# Altium schematic sheet Array.SchDoc (part 3 of 3)
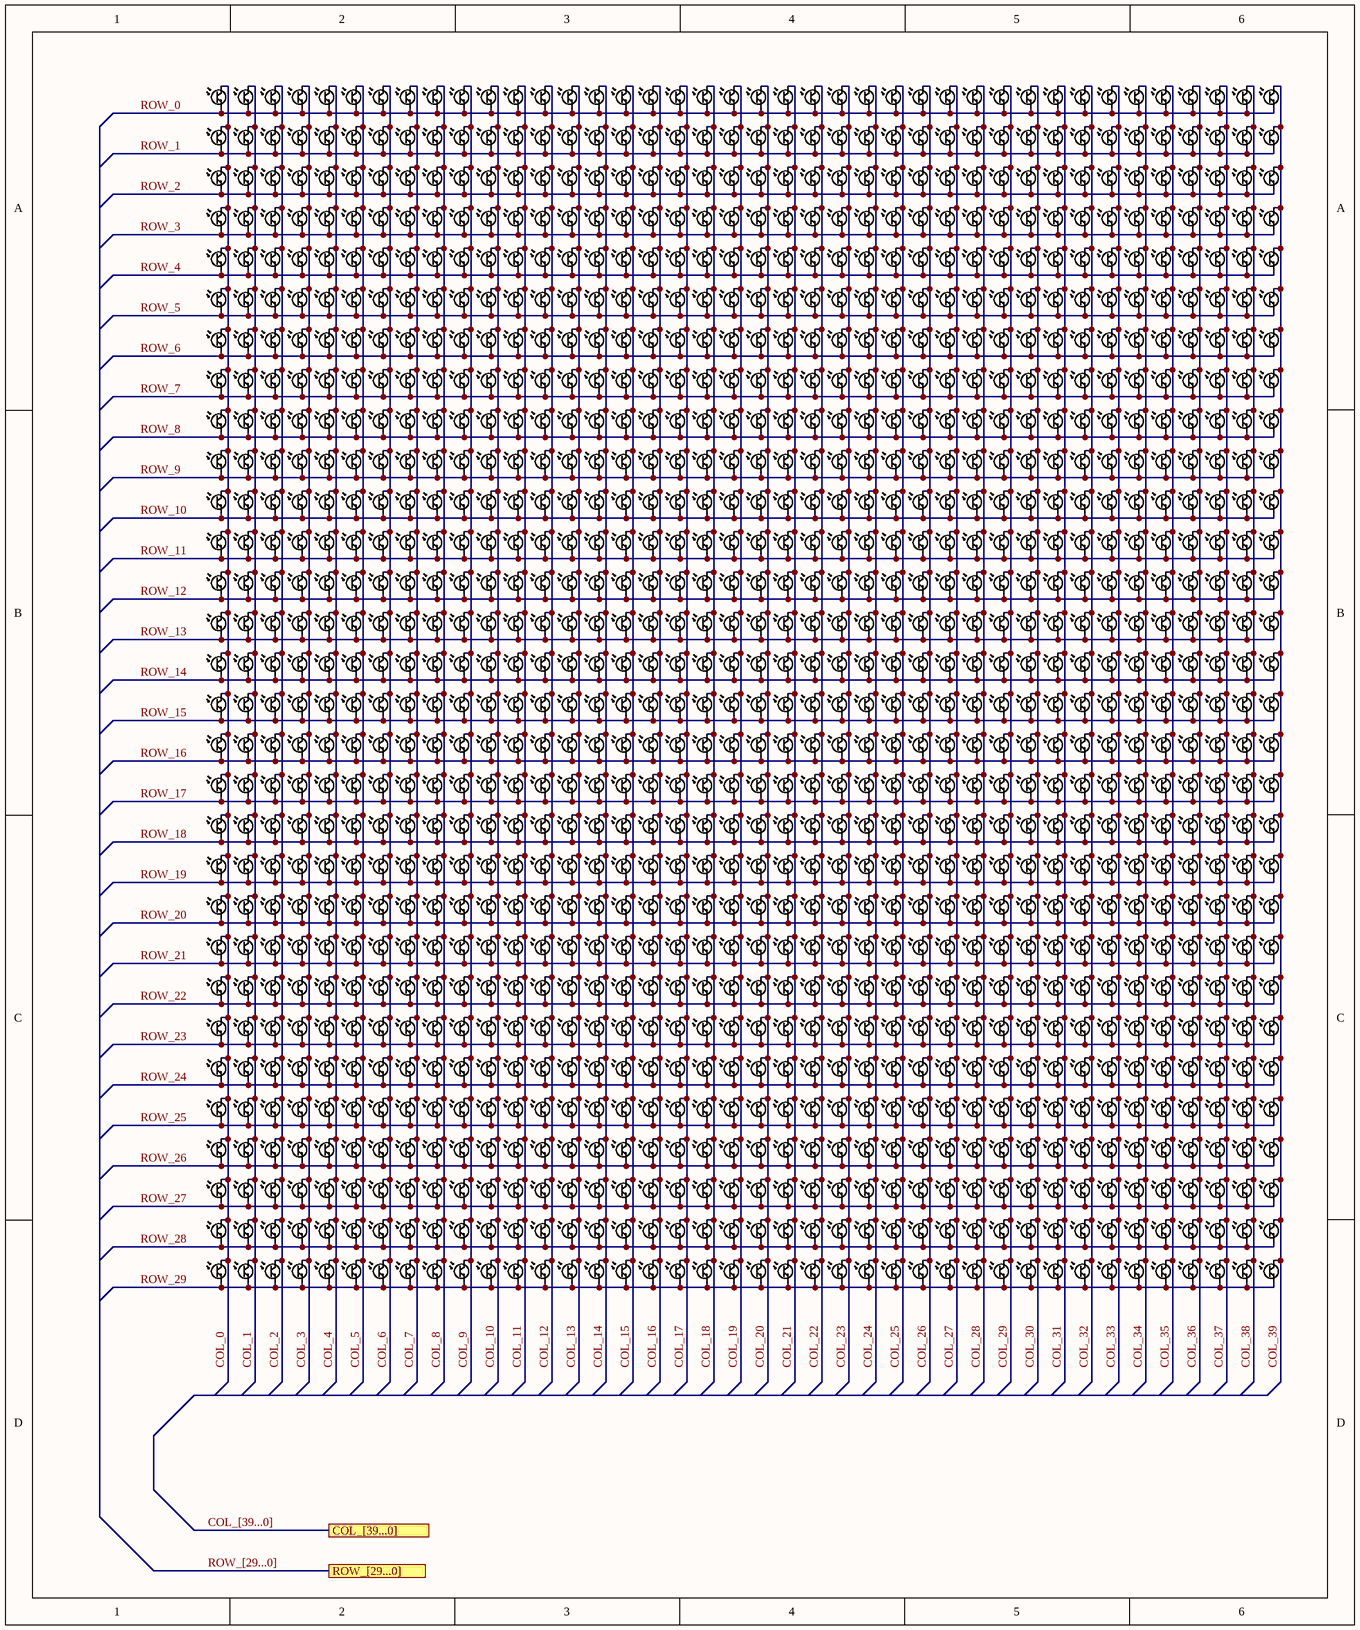
[diagram p2: Array.SchDoc]

## Parts (continued)
Q864  PT0805CS  [0805 Phototransistor]  (value not drawn)
Q865  PT0805CS  [0805 Phototransistor]  (value not drawn)
Q866  PT0805CS  [0805 Phototransistor]  (value not drawn)
Q867  PT0805CS  [0805 Phototransistor]  (value not drawn)
Q868  PT0805CS  [0805 Phototransistor]  (value not drawn)
Q869  PT0805CS  [0805 Phototransistor]  (value not drawn)
Q870  PT0805CS  [0805 Phototransistor]  (value not drawn)
Q871  PT0805CS  [0805 Phototransistor]  (value not drawn)
Q872  PT0805CS  [0805 Phototransistor]  (value not drawn)
Q873  PT0805CS  [0805 Phototransistor]  (value not drawn)
Q874  PT0805CS  [0805 Phototransistor]  (value not drawn)
Q875  PT0805CS  [0805 Phototransistor]  (value not drawn)
Q876  PT0805CS  [0805 Phototransistor]  (value not drawn)
Q877  PT0805CS  [0805 Phototransistor]  (value not drawn)
Q878  PT0805CS  [0805 Phototransistor]  (value not drawn)
Q879  PT0805CS  [0805 Phototransistor]  (value not drawn)
Q880  PT0805CS  [0805 Phototransistor]  (value not drawn)
Q881  PT0805CS  [0805 Phototransistor]  (value not drawn)
Q882  PT0805CS  [0805 Phototransistor]  (value not drawn)
Q883  PT0805CS  [0805 Phototransistor]  (value not drawn)
Q884  PT0805CS  [0805 Phototransistor]  (value not drawn)
Q885  PT0805CS  [0805 Phototransistor]  (value not drawn)
Q886  PT0805CS  [0805 Phototransistor]  (value not drawn)
Q887  PT0805CS  [0805 Phototransistor]  (value not drawn)
Q888  PT0805CS  [0805 Phototransistor]  (value not drawn)
Q889  PT0805CS  [0805 Phototransistor]  (value not drawn)
Q890  PT0805CS  [0805 Phototransistor]  (value not drawn)
Q891  PT0805CS  [0805 Phototransistor]  (value not drawn)
Q892  PT0805CS  [0805 Phototransistor]  (value not drawn)
Q893  PT0805CS  [0805 Phototransistor]  (value not drawn)
Q894  PT0805CS  [0805 Phototransistor]  (value not drawn)
Q895  PT0805CS  [0805 Phototransistor]  (value not drawn)
Q896  PT0805CS  [0805 Phototransistor]  (value not drawn)
Q897  PT0805CS  [0805 Phototransistor]  (value not drawn)
Q898  PT0805CS  [0805 Phototransistor]  (value not drawn)
Q899  PT0805CS  [0805 Phototransistor]  (value not drawn)
Q900  PT0805CS  [0805 Phototransistor]  (value not drawn)
Q901  PT0805CS  [0805 Phototransistor]  (value not drawn)
Q902  PT0805CS  [0805 Phototransistor]  (value not drawn)
Q903  PT0805CS  [0805 Phototransistor]  (value not drawn)
Q904  PT0805CS  [0805 Phototransistor]  (value not drawn)
Q905  PT0805CS  [0805 Phototransistor]  (value not drawn)
Q906  PT0805CS  [0805 Phototransistor]  (value not drawn)
Q907  PT0805CS  [0805 Phototransistor]  (value not drawn)
Q908  PT0805CS  [0805 Phototransistor]  (value not drawn)
Q909  PT0805CS  [0805 Phototransistor]  (value not drawn)
Q910  PT0805CS  [0805 Phototransistor]  (value not drawn)
Q911  PT0805CS  [0805 Phototransistor]  (value not drawn)
Q912  PT0805CS  [0805 Phototransistor]  (value not drawn)
Q913  PT0805CS  [0805 Phototransistor]  (value not drawn)
Q914  PT0805CS  [0805 Phototransistor]  (value not drawn)
Q915  PT0805CS  [0805 Phototransistor]  (value not drawn)
Q916  PT0805CS  [0805 Phototransistor]  (value not drawn)
Q917  PT0805CS  [0805 Phototransistor]  (value not drawn)
Q918  PT0805CS  [0805 Phototransistor]  (value not drawn)
Q919  PT0805CS  [0805 Phototransistor]  (value not drawn)
Q920  PT0805CS  [0805 Phototransistor]  (value not drawn)
Q921  PT0805CS  [0805 Phototransistor]  (value not drawn)
Q922  PT0805CS  [0805 Phototransistor]  (value not drawn)
Q923  PT0805CS  [0805 Phototransistor]  (value not drawn)
Q924  PT0805CS  [0805 Phototransistor]  (value not drawn)
Q925  PT0805CS  [0805 Phototransistor]  (value not drawn)
Q926  PT0805CS  [0805 Phototransistor]  (value not drawn)
Q927  PT0805CS  [0805 Phototransistor]  (value not drawn)
Q928  PT0805CS  [0805 Phototransistor]  (value not drawn)
Q929  PT0805CS  [0805 Phototransistor]  (value not drawn)
Q930  PT0805CS  [0805 Phototransistor]  (value not drawn)
Q931  PT0805CS  [0805 Phototransistor]  (value not drawn)
Q932  PT0805CS  [0805 Phototransistor]  (value not drawn)
Q933  PT0805CS  [0805 Phototransistor]  (value not drawn)
Q934  PT0805CS  [0805 Phototransistor]  (value not drawn)
Q935  PT0805CS  [0805 Phototransistor]  (value not drawn)
Q936  PT0805CS  [0805 Phototransistor]  (value not drawn)
Q937  PT0805CS  [0805 Phototransistor]  (value not drawn)
Q938  PT0805CS  [0805 Phototransistor]  (value not drawn)
Q939  PT0805CS  [0805 Phototransistor]  (value not drawn)
Q940  PT0805CS  [0805 Phototransistor]  (value not drawn)
Q941  PT0805CS  [0805 Phototransistor]  (value not drawn)
Q942  PT0805CS  [0805 Phototransistor]  (value not drawn)
Q943  PT0805CS  [0805 Phototransistor]  (value not drawn)
Q944  PT0805CS  [0805 Phototransistor]  (value not drawn)
Q945  PT0805CS  [0805 Phototransistor]  (value not drawn)
Q946  PT0805CS  [0805 Phototransistor]  (value not drawn)
Q947  PT0805CS  [0805 Phototransistor]  (value not drawn)
Q948  PT0805CS  [0805 Phototransistor]  (value not drawn)
Q949  PT0805CS  [0805 Phototransistor]  (value not drawn)
Q950  PT0805CS  [0805 Phototransistor]  (value not drawn)
Q951  PT0805CS  [0805 Phototransistor]  (value not drawn)
Q952  PT0805CS  [0805 Phototransistor]  (value not drawn)
Q953  PT0805CS  [0805 Phototransistor]  (value not drawn)
Q954  PT0805CS  [0805 Phototransistor]  (value not drawn)
Q955  PT0805CS  [0805 Phototransistor]  (value not drawn)
Q956  PT0805CS  [0805 Phototransistor]  (value not drawn)
Q957  PT0805CS  [0805 Phototransistor]  (value not drawn)
Q958  PT0805CS  [0805 Phototransistor]  (value not drawn)
Q959  PT0805CS  [0805 Phototransistor]  (value not drawn)
Q960  PT0805CS  [0805 Phototransistor]  (value not drawn)
Q961  PT0805CS  [0805 Phototransistor]  (value not drawn)
Q962  PT0805CS  [0805 Phototransistor]  (value not drawn)
Q963  PT0805CS  [0805 Phototransistor]  (value not drawn)
Q964  PT0805CS  [0805 Phototransistor]  (value not drawn)
Q965  PT0805CS  [0805 Phototransistor]  (value not drawn)
Q966  PT0805CS  [0805 Phototransistor]  (value not drawn)
Q967  PT0805CS  [0805 Phototransistor]  (value not drawn)
Q968  PT0805CS  [0805 Phototransistor]  (value not drawn)
Q969  PT0805CS  [0805 Phototransistor]  (value not drawn)
Q970  PT0805CS  [0805 Phototransistor]  (value not drawn)
Q971  PT0805CS  [0805 Phototransistor]  (value not drawn)
Q972  PT0805CS  [0805 Phototransistor]  (value not drawn)
Q973  PT0805CS  [0805 Phototransistor]  (value not drawn)
Q974  PT0805CS  [0805 Phototransistor]  (value not drawn)
Q975  PT0805CS  [0805 Phototransistor]  (value not drawn)
Q976  PT0805CS  [0805 Phototransistor]  (value not drawn)
Q977  PT0805CS  [0805 Phototransistor]  (value not drawn)
Q978  PT0805CS  [0805 Phototransistor]  (value not drawn)
Q979  PT0805CS  [0805 Phototransistor]  (value not drawn)
Q980  PT0805CS  [0805 Phototransistor]  (value not drawn)
Q981  PT0805CS  [0805 Phototransistor]  (value not drawn)
Q982  PT0805CS  [0805 Phototransistor]  (value not drawn)
Q983  PT0805CS  [0805 Phototransistor]  (value not drawn)
Q984  PT0805CS  [0805 Phototransistor]  (value not drawn)
Q985  PT0805CS  [0805 Phototransistor]  (value not drawn)
Q986  PT0805CS  [0805 Phototransistor]  (value not drawn)
Q987  PT0805CS  [0805 Phototransistor]  (value not drawn)
Q988  PT0805CS  [0805 Phototransistor]  (value not drawn)
Q989  PT0805CS  [0805 Phototransistor]  (value not drawn)
Q990  PT0805CS  [0805 Phototransistor]  (value not drawn)
Q991  PT0805CS  [0805 Phototransistor]  (value not drawn)
Q992  PT0805CS  [0805 Phototransistor]  (value not drawn)
Q993  PT0805CS  [0805 Phototransistor]  (value not drawn)
Q994  PT0805CS  [0805 Phototransistor]  (value not drawn)
Q995  PT0805CS  [0805 Phototransistor]  (value not drawn)
Q996  PT0805CS  [0805 Phototransistor]  (value not drawn)
Q997  PT0805CS  [0805 Phototransistor]  (value not drawn)
Q998  PT0805CS  [0805 Phototransistor]  (value not drawn)
Q999  PT0805CS  [0805 Phototransistor]  (value not drawn)
Q1000  PT0805CS  [0805 Phototransistor]  (value not drawn)
Q1001  PT0805CS  [0805 Phototransistor]  (value not drawn)
Q1002  PT0805CS  [0805 Phototransistor]  (value not drawn)
Q1003  PT0805CS  [0805 Phototransistor]  (value not drawn)
Q1004  PT0805CS  [0805 Phototransistor]  (value not drawn)
Q1005  PT0805CS  [0805 Phototransistor]  (value not drawn)
Q1006  PT0805CS  [0805 Phototransistor]  (value not drawn)
Q1007  PT0805CS  [0805 Phototransistor]  (value not drawn)
Q1008  PT0805CS  [0805 Phototransistor]  (value not drawn)
Q1009  PT0805CS  [0805 Phototransistor]  (value not drawn)
Q1010  PT0805CS  [0805 Phototransistor]  (value not drawn)
Q1011  PT0805CS  [0805 Phototransistor]  (value not drawn)
Q1012  PT0805CS  [0805 Phototransistor]  (value not drawn)
Q1013  PT0805CS  [0805 Phototransistor]  (value not drawn)
Q1014  PT0805CS  [0805 Phototransistor]  (value not drawn)
Q1015  PT0805CS  [0805 Phototransistor]  (value not drawn)
Q1016  PT0805CS  [0805 Phototransistor]  (value not drawn)
Q1017  PT0805CS  [0805 Phototransistor]  (value not drawn)
Q1018  PT0805CS  [0805 Phototransistor]  (value not drawn)
Q1019  PT0805CS  [0805 Phototransistor]  (value not drawn)
Q1020  PT0805CS  [0805 Phototransistor]  (value not drawn)
Q1021  PT0805CS  [0805 Phototransistor]  (value not drawn)
Q1022  PT0805CS  [0805 Phototransistor]  (value not drawn)
Q1023  PT0805CS  [0805 Phototransistor]  (value not drawn)
Q1024  PT0805CS  [0805 Phototransistor]  (value not drawn)
Q1025  PT0805CS  [0805 Phototransistor]  (value not drawn)
Q1026  PT0805CS  [0805 Phototransistor]  (value not drawn)
Q1027  PT0805CS  [0805 Phototransistor]  (value not drawn)
Q1028  PT0805CS  [0805 Phototransistor]  (value not drawn)
Q1029  PT0805CS  [0805 Phototransistor]  (value not drawn)
Q1030  PT0805CS  [0805 Phototransistor]  (value not drawn)
Q1031  PT0805CS  [0805 Phototransistor]  (value not drawn)
Q1032  PT0805CS  [0805 Phototransistor]  (value not drawn)
Q1033  PT0805CS  [0805 Phototransistor]  (value not drawn)
Q1034  PT0805CS  [0805 Phototransistor]  (value not drawn)
Q1035  PT0805CS  [0805 Phototransistor]  (value not drawn)
Q1036  PT0805CS  [0805 Phototransistor]  (value not drawn)
Q1037  PT0805CS  [0805 Phototransistor]  (value not drawn)
Q1038  PT0805CS  [0805 Phototransistor]  (value not drawn)
Q1039  PT0805CS  [0805 Phototransistor]  (value not drawn)
Q1040  PT0805CS  [0805 Phototransistor]  (value not drawn)
Q1041  PT0805CS  [0805 Phototransistor]  (value not drawn)
Q1042  PT0805CS  [0805 Phototransistor]  (value not drawn)
Q1043  PT0805CS  [0805 Phototransistor]  (value not drawn)
Q1044  PT0805CS  [0805 Phototransistor]  (value not drawn)
Q1045  PT0805CS  [0805 Phototransistor]  (value not drawn)
Q1046  PT0805CS  [0805 Phototransistor]  (value not drawn)
Q1047  PT0805CS  [0805 Phototransistor]  (value not drawn)
Q1048  PT0805CS  [0805 Phototransistor]  (value not drawn)
Q1049  PT0805CS  [0805 Phototransistor]  (value not drawn)
Q1050  PT0805CS  [0805 Phototransistor]  (value not drawn)
Q1051  PT0805CS  [0805 Phototransistor]  (value not drawn)
Q1052  PT0805CS  [0805 Phototransistor]  (value not drawn)
Q1053  PT0805CS  [0805 Phototransistor]  (value not drawn)
Q1054  PT0805CS  [0805 Phototransistor]  (value not drawn)
Q1055  PT0805CS  [0805 Phototransistor]  (value not drawn)
Q1056  PT0805CS  [0805 Phototransistor]  (value not drawn)
Q1057  PT0805CS  [0805 Phototransistor]  (value not drawn)
Q1058  PT0805CS  [0805 Phototransistor]  (value not drawn)
Q1059  PT0805CS  [0805 Phototransistor]  (value not drawn)
Q1060  PT0805CS  [0805 Phototransistor]  (value not drawn)
Q1061  PT0805CS  [0805 Phototransistor]  (value not drawn)
Q1062  PT0805CS  [0805 Phototransistor]  (value not drawn)
Q1063  PT0805CS  [0805 Phototransistor]  (value not drawn)
Q1064  PT0805CS  [0805 Phototransistor]  (value not drawn)
Q1065  PT0805CS  [0805 Phototransistor]  (value not drawn)
Q1066  PT0805CS  [0805 Phototransistor]  (value not drawn)
Q1067  PT0805CS  [0805 Phototransistor]  (value not drawn)
Q1068  PT0805CS  [0805 Phototransistor]  (value not drawn)
Q1069  PT0805CS  [0805 Phototransistor]  (value not drawn)
Q1070  PT0805CS  [0805 Phototransistor]  (value not drawn)
Q1071  PT0805CS  [0805 Phototransistor]  (value not drawn)
Q1072  PT0805CS  [0805 Phototransistor]  (value not drawn)
Q1073  PT0805CS  [0805 Phototransistor]  (value not drawn)
Q1074  PT0805CS  [0805 Phototransistor]  (value not drawn)
Q1075  PT0805CS  [0805 Phototransistor]  (value not drawn)
Q1076  PT0805CS  [0805 Phototransistor]  (value not drawn)
Q1077  PT0805CS  [0805 Phototransistor]  (value not drawn)
Q1078  PT0805CS  [0805 Phototransistor]  (value not drawn)
Q1079  PT0805CS  [0805 Phototransistor]  (value not drawn)
Q1080  PT0805CS  [0805 Phototransistor]  (value not drawn)
Q1081  PT0805CS  [0805 Phototransistor]  (value not drawn)
Q1082  PT0805CS  [0805 Phototransistor]  (value not drawn)
Q1083  PT0805CS  [0805 Phototransistor]  (value not drawn)
Q1084  PT0805CS  [0805 Phototransistor]  (value not drawn)
Q1085  PT0805CS  [0805 Phototransistor]  (value not drawn)
Q1086  PT0805CS  [0805 Phototransistor]  (value not drawn)
Q1087  PT0805CS  [0805 Phototransistor]  (value not drawn)
Q1088  PT0805CS  [0805 Phototransistor]  (value not drawn)
Q1089  PT0805CS  [0805 Phototransistor]  (value not drawn)
Q1090  PT0805CS  [0805 Phototransistor]  (value not drawn)
Q1091  PT0805CS  [0805 Phototransistor]  (value not drawn)
Q1092  PT0805CS  [0805 Phototransistor]  (value not drawn)
Q1093  PT0805CS  [0805 Phototransistor]  (value not drawn)
Q1094  PT0805CS  [0805 Phototransistor]  (value not drawn)
Q1095  PT0805CS  [0805 Phototransistor]  (value not drawn)
Q1096  PT0805CS  [0805 Phototransistor]  (value not drawn)
Q1097  PT0805CS  [0805 Phototransistor]  (value not drawn)
Q1098  PT0805CS  [0805 Phototransistor]  (value not drawn)
Q1099  PT0805CS  [0805 Phototransistor]  (value not drawn)
Q1100  PT0805CS  [0805 Phototransistor]  (value not drawn)
Q1101  PT0805CS  [0805 Phototransistor]  (value not drawn)
Q1102  PT0805CS  [0805 Phototransistor]  (value not drawn)
Q1103  PT0805CS  [0805 Phototransistor]  (value not drawn)
Q1104  PT0805CS  [0805 Phototransistor]  (value not drawn)
Q1105  PT0805CS  [0805 Phototransistor]  (value not drawn)
Q1106  PT0805CS  [0805 Phototransistor]  (value not drawn)
Q1107  PT0805CS  [0805 Phototransistor]  (value not drawn)
Q1108  PT0805CS  [0805 Phototransistor]  (value not drawn)
Q1109  PT0805CS  [0805 Phototransistor]  (value not drawn)
Q1110  PT0805CS  [0805 Phototransistor]  (value not drawn)
Q1111  PT0805CS  [0805 Phototransistor]  (value not drawn)
Q1112  PT0805CS  [0805 Phototransistor]  (value not drawn)
Q1113  PT0805CS  [0805 Phototransistor]  (value not drawn)
Q1114  PT0805CS  [0805 Phototransistor]  (value not drawn)
Q1115  PT0805CS  [0805 Phototransistor]  (value not drawn)
Q1116  PT0805CS  [0805 Phototransistor]  (value not drawn)
Q1117  PT0805CS  [0805 Phototransistor]  (value not drawn)
Q1118  PT0805CS  [0805 Phototransistor]  (value not drawn)
Q1119  PT0805CS  [0805 Phototransistor]  (value not drawn)
Q1120  PT0805CS  [0805 Phototransistor]  (value not drawn)
Q1121  PT0805CS  [0805 Phototransistor]  (value not drawn)
Q1122  PT0805CS  [0805 Phototransistor]  (value not drawn)
Q1123  PT0805CS  [0805 Phototransistor]  (value not drawn)
Q1124  PT0805CS  [0805 Phototransistor]  (value not drawn)
Q1125  PT0805CS  [0805 Phototransistor]  (value not drawn)
Q1126  PT0805CS  [0805 Phototransistor]  (value not drawn)
Q1127  PT0805CS  [0805 Phototransistor]  (value not drawn)
Q1128  PT0805CS  [0805 Phototransistor]  (value not drawn)
Q1129  PT0805CS  [0805 Phototransistor]  (value not drawn)
Q1130  PT0805CS  [0805 Phototransistor]  (value not drawn)
Q1131  PT0805CS  [0805 Phototransistor]  (value not drawn)
Q1132  PT0805CS  [0805 Phototransistor]  (value not drawn)
Q1133  PT0805CS  [0805 Phototransistor]  (value not drawn)
Q1134  PT0805CS  [0805 Phototransistor]  (value not drawn)
Q1135  PT0805CS  [0805 Phototransistor]  (value not drawn)
Q1136  PT0805CS  [0805 Phototransistor]  (value not drawn)
Q1137  PT0805CS  [0805 Phototransistor]  (value not drawn)
Q1138  PT0805CS  [0805 Phototransistor]  (value not drawn)
Q1139  PT0805CS  [0805 Phototransistor]  (value not drawn)
Q1140  PT0805CS  [0805 Phototransistor]  (value not drawn)
Q1141  PT0805CS  [0805 Phototransistor]  (value not drawn)
Q1142  PT0805CS  [0805 Phototransistor]  (value not drawn)
Q1143  PT0805CS  [0805 Phototransistor]  (value not drawn)
Q1144  PT0805CS  [0805 Phototransistor]  (value not drawn)
Q1145  PT0805CS  [0805 Phototransistor]  (value not drawn)
Q1146  PT0805CS  [0805 Phototransistor]  (value not drawn)
Q1147  PT0805CS  [0805 Phototransistor]  (value not drawn)
Q1148  PT0805CS  [0805 Phototransistor]  (value not drawn)
Q1149  PT0805CS  [0805 Phototransistor]  (value not drawn)
Q1150  PT0805CS  [0805 Phototransistor]  (value not drawn)
Q1151  PT0805CS  [0805 Phototransistor]  (value not drawn)
Q1152  PT0805CS  [0805 Phototransistor]  (value not drawn)
Q1153  PT0805CS  [0805 Phototransistor]  (value not drawn)
Q1154  PT0805CS  [0805 Phototransistor]  (value not drawn)
Q1155  PT0805CS  [0805 Phototransistor]  (value not drawn)
Q1156  PT0805CS  [0805 Phototransistor]  (value not drawn)
Q1157  PT0805CS  [0805 Phototransistor]  (value not drawn)
Q1158  PT0805CS  [0805 Phototransistor]  (value not drawn)
Q1159  PT0805CS  [0805 Phototransistor]  (value not drawn)
Q1160  PT0805CS  [0805 Phototransistor]  (value not drawn)
Q1161  PT0805CS  [0805 Phototransistor]  (value not drawn)
Q1162  PT0805CS  [0805 Phototransistor]  (value not drawn)
Q1163  PT0805CS  [0805 Phototransistor]  (value not drawn)
Q1164  PT0805CS  [0805 Phototransistor]  (value not drawn)
Q1165  PT0805CS  [0805 Phototransistor]  (value not drawn)
Q1166  PT0805CS  [0805 Phototransistor]  (value not drawn)
Q1167  PT0805CS  [0805 Phototransistor]  (value not drawn)
Q1168  PT0805CS  [0805 Phototransistor]  (value not drawn)
Q1169  PT0805CS  [0805 Phototransistor]  (value not drawn)
Q1170  PT0805CS  [0805 Phototransistor]  (value not drawn)
Q1171  PT0805CS  [0805 Phototransistor]  (value not drawn)
Q1172  PT0805CS  [0805 Phototransistor]  (value not drawn)
Q1173  PT0805CS  [0805 Phototransistor]  (value not drawn)
Q1174  PT0805CS  [0805 Phototransistor]  (value not drawn)
Q1175  PT0805CS  [0805 Phototransistor]  (value not drawn)
Q1176  PT0805CS  [0805 Phototransistor]  (value not drawn)
Q1177  PT0805CS  [0805 Phototransistor]  (value not drawn)
Q1178  PT0805CS  [0805 Phototransistor]  (value not drawn)
Q1179  PT0805CS  [0805 Phototransistor]  (value not drawn)
Q1180  PT0805CS  [0805 Phototransistor]  (value not drawn)
Q1181  PT0805CS  [0805 Phototransistor]  (value not drawn)
Q1182  PT0805CS  [0805 Phototransistor]  (value not drawn)
Q1183  PT0805CS  [0805 Phototransistor]  (value not drawn)
Q1184  PT0805CS  [0805 Phototransistor]  (value not drawn)
Q1185  PT0805CS  [0805 Phototransistor]  (value not drawn)
Q1186  PT0805CS  [0805 Phototransistor]  (value not drawn)
Q1187  PT0805CS  [0805 Phototransistor]  (value not drawn)
Q1188  PT0805CS  [0805 Phototransistor]  (value not drawn)
Q1189  PT0805CS  [0805 Phototransistor]  (value not drawn)
Q1190  PT0805CS  [0805 Phototransistor]  (value not drawn)
Q1191  PT0805CS  [0805 Phototransistor]  (value not drawn)
Q1192  PT0805CS  [0805 Phototransistor]  (value not drawn)
Q1193  PT0805CS  [0805 Phototransistor]  (value not drawn)
Q1194  PT0805CS  [0805 Phototransistor]  (value not drawn)
Q1195  PT0805CS  [0805 Phototransistor]  (value not drawn)
Q1196  PT0805CS  [0805 Phototransistor]  (value not drawn)
Q1197  PT0805CS  [0805 Phototransistor]  (value not drawn)
Q1198  PT0805CS  [0805 Phototransistor]  (value not drawn)
Q1199  PT0805CS  [0805 Phototransistor]  (value not drawn)
Q1200  PT0805CS  [0805 Phototransistor]  (value not drawn)

## Ports
COL_[39...0], ROW_[29...0]

## Nets
COL_0: Q1.C Q41.C Q81.C Q121.C Q161.C Q201.C Q241.C Q281.C Q321.C Q361.C Q401.C Q441.C Q481.C Q521.C Q561.C Q601.C Q641.C Q681.C Q721.C Q761.C Q801.C Q841.C Q881.C Q921.C Q961.C Q1001.C Q1041.C Q1081.C Q1121.C Q1161.C
COL_1: Q2.C Q42.C Q82.C Q122.C Q162.C Q202.C Q242.C Q282.C Q322.C Q362.C Q402.C Q442.C Q482.C Q522.C Q562.C Q602.C Q642.C Q682.C Q722.C Q762.C Q802.C Q842.C Q882.C Q922.C Q962.C Q1002.C Q1042.C Q1082.C Q1122.C Q1162.C
COL_2: Q3.C Q43.C Q83.C Q123.C Q163.C Q203.C Q243.C Q283.C Q323.C Q363.C Q403.C Q443.C Q483.C Q523.C Q563.C Q603.C Q643.C Q683.C Q723.C Q763.C Q803.C Q843.C Q883.C Q923.C Q963.C Q1003.C Q1043.C Q1083.C Q1123.C Q1163.C
COL_3: Q4.C Q44.C Q84.C Q124.C Q164.C Q204.C Q244.C Q284.C Q324.C Q364.C Q404.C Q444.C Q484.C Q524.C Q564.C Q604.C Q644.C Q684.C Q724.C Q764.C Q804.C Q844.C Q884.C Q924.C Q964.C Q1004.C Q1044.C Q1084.C Q1124.C Q1164.C
COL_4: Q5.C Q45.C Q85.C Q125.C Q165.C Q205.C Q245.C Q285.C Q325.C Q365.C Q405.C Q445.C Q485.C Q525.C Q565.C Q605.C Q645.C Q685.C Q725.C Q765.C Q805.C Q845.C Q885.C Q925.C Q965.C Q1005.C Q1045.C Q1085.C Q1125.C Q1165.C
COL_5: Q6.C Q46.C Q86.C Q126.C Q166.C Q206.C Q246.C Q286.C Q326.C Q366.C Q406.C Q446.C Q486.C Q526.C Q566.C Q606.C Q646.C Q686.C Q726.C Q766.C Q806.C Q846.C Q886.C Q926.C Q966.C Q1006.C Q1046.C Q1086.C Q1126.C Q1166.C
COL_6: Q7.C Q47.C Q87.C Q127.C Q167.C Q207.C Q247.C Q287.C Q327.C Q367.C Q407.C Q447.C Q487.C Q527.C Q567.C Q607.C Q647.C Q687.C Q727.C Q767.C Q807.C Q847.C Q887.C Q927.C Q967.C Q1007.C Q1047.C Q1087.C Q1127.C Q1167.C
COL_7: Q8.C Q48.C Q88.C Q128.C Q168.C Q208.C Q248.C Q288.C Q328.C Q368.C Q408.C Q448.C Q488.C Q528.C Q568.C Q608.C Q648.C Q688.C Q728.C Q768.C Q808.C Q848.C Q888.C Q928.C Q968.C Q1008.C Q1048.C Q1088.C Q1128.C Q1168.C
COL_8: Q9.C Q49.C Q89.C Q129.C Q169.C Q209.C Q249.C Q289.C Q329.C Q369.C Q409.C Q449.C Q489.C Q529.C Q569.C Q609.C Q649.C Q689.C Q729.C Q769.C Q809.C Q849.C Q889.C Q929.C Q969.C Q1009.C Q1049.C Q1089.C Q1129.C Q1169.C
COL_9: Q10.C Q50.C Q90.C Q130.C Q170.C Q210.C Q250.C Q290.C Q330.C Q370.C Q410.C Q450.C Q490.C Q530.C Q570.C Q610.C Q650.C Q690.C Q730.C Q770.C Q810.C Q850.C Q890.C Q930.C Q970.C Q1010.C Q1050.C Q1090.C Q1130.C Q1170.C
COL_10: Q11.C Q51.C Q91.C Q131.C Q171.C Q211.C Q251.C Q291.C Q331.C Q371.C Q411.C Q451.C Q491.C Q531.C Q571.C Q611.C Q651.C Q691.C Q731.C Q771.C Q811.C Q851.C Q891.C Q931.C Q971.C Q1011.C Q1051.C Q1091.C Q1131.C Q1171.C
COL_11: Q12.C Q52.C Q92.C Q132.C Q172.C Q212.C Q252.C Q292.C Q332.C Q372.C Q412.C Q452.C Q492.C Q532.C Q572.C Q612.C Q652.C Q692.C Q732.C Q772.C Q812.C Q852.C Q892.C Q932.C Q972.C Q1012.C Q1052.C Q1092.C Q1132.C Q1172.C
COL_12: Q13.C Q53.C Q93.C Q133.C Q173.C Q213.C Q253.C Q293.C Q333.C Q373.C Q413.C Q453.C Q493.C Q533.C Q573.C Q613.C Q653.C Q693.C Q733.C Q773.C Q813.C Q853.C Q893.C Q933.C Q973.C Q1013.C Q1053.C Q1093.C Q1133.C Q1173.C
COL_13: Q14.C Q54.C Q94.C Q134.C Q174.C Q214.C Q254.C Q294.C Q334.C Q374.C Q414.C Q454.C Q494.C Q534.C Q574.C Q614.C Q654.C Q694.C Q734.C Q774.C Q814.C Q854.C Q894.C Q934.C Q974.C Q1014.C Q1054.C Q1094.C Q1134.C Q1174.C
COL_14: Q15.C Q55.C Q95.C Q135.C Q175.C Q215.C Q255.C Q295.C Q335.C Q375.C Q415.C Q455.C Q495.C Q535.C Q575.C Q615.C Q655.C Q695.C Q735.C Q775.C Q815.C Q855.C Q895.C Q935.C Q975.C Q1015.C Q1055.C Q1095.C Q1135.C Q1175.C
COL_15: Q16.C Q56.C Q96.C Q136.C Q176.C Q216.C Q256.C Q296.C Q336.C Q376.C Q416.C Q456.C Q496.C Q536.C Q576.C Q616.C Q656.C Q696.C Q736.C Q776.C Q816.C Q856.C Q896.C Q936.C Q976.C Q1016.C Q1056.C Q1096.C Q1136.C Q1176.C
COL_16: Q17.C Q57.C Q97.C Q137.C Q177.C Q217.C Q257.C Q297.C Q337.C Q377.C Q417.C Q457.C Q497.C Q537.C Q577.C Q617.C Q657.C Q697.C Q737.C Q777.C Q817.C Q857.C Q897.C Q937.C Q977.C Q1017.C Q1057.C Q1097.C Q1137.C Q1177.C
COL_17: Q18.C Q58.C Q98.C Q138.C Q178.C Q218.C Q258.C Q298.C Q338.C Q378.C Q418.C Q458.C Q498.C Q538.C Q578.C Q618.C Q658.C Q698.C Q738.C Q778.C Q818.C Q858.C Q898.C Q938.C Q978.C Q1018.C Q1058.C Q1098.C Q1138.C Q1178.C
COL_18: Q19.C Q59.C Q99.C Q139.C Q179.C Q219.C Q259.C Q299.C Q339.C Q379.C Q419.C Q459.C Q499.C Q539.C Q579.C Q619.C Q659.C Q699.C Q739.C Q779.C Q819.C Q859.C Q899.C Q939.C Q979.C Q1019.C Q1059.C Q1099.C Q1139.C Q1179.C
COL_19: Q20.C Q60.C Q100.C Q140.C Q180.C Q220.C Q260.C Q300.C Q340.C Q380.C Q420.C Q460.C Q500.C Q540.C Q580.C Q620.C Q660.C Q700.C Q740.C Q780.C Q820.C Q860.C Q900.C Q940.C Q980.C Q1020.C Q1060.C Q1100.C Q1140.C Q1180.C
COL_20: Q21.C Q61.C Q101.C Q141.C Q181.C Q221.C Q261.C Q301.C Q341.C Q381.C Q421.C Q461.C Q501.C Q541.C Q581.C Q621.C Q661.C Q701.C Q741.C Q781.C Q821.C Q861.C Q901.C Q941.C Q981.C Q1021.C Q1061.C Q1101.C Q1141.C Q1181.C
COL_21: Q22.C Q62.C Q102.C Q142.C Q182.C Q222.C Q262.C Q302.C Q342.C Q382.C Q422.C Q462.C Q502.C Q542.C Q582.C Q622.C Q662.C Q702.C Q742.C Q782.C Q822.C Q862.C Q902.C Q942.C Q982.C Q1022.C Q1062.C Q1102.C Q1142.C Q1182.C
COL_22: Q23.C Q63.C Q103.C Q143.C Q183.C Q223.C Q263.C Q303.C Q343.C Q383.C Q423.C Q463.C Q503.C Q543.C Q583.C Q623.C Q663.C Q703.C Q743.C Q783.C Q823.C Q863.C Q903.C Q943.C Q983.C Q1023.C Q1063.C Q1103.C Q1143.C Q1183.C
COL_23: Q24.C Q64.C Q104.C Q144.C Q184.C Q224.C Q264.C Q304.C Q344.C Q384.C Q424.C Q464.C Q504.C Q544.C Q584.C Q624.C Q664.C Q704.C Q744.C Q784.C Q824.C Q864.C Q904.C Q944.C Q984.C Q1024.C Q1064.C Q1104.C Q1144.C Q1184.C
COL_24: Q25.C Q65.C Q105.C Q145.C Q185.C Q225.C Q265.C Q305.C Q345.C Q385.C Q425.C Q465.C Q505.C Q545.C Q585.C Q625.C Q665.C Q705.C Q745.C Q785.C Q825.C Q865.C Q905.C Q945.C Q985.C Q1025.C Q1065.C Q1105.C Q1145.C Q1185.C
COL_25: Q26.C Q66.C Q106.C Q146.C Q186.C Q226.C Q266.C Q306.C Q346.C Q386.C Q426.C Q466.C Q506.C Q546.C Q586.C Q626.C Q666.C Q706.C Q746.C Q786.C Q826.C Q866.C Q906.C Q946.C Q986.C Q1026.C Q1066.C Q1106.C Q1146.C Q1186.C
COL_26: Q27.C Q67.C Q107.C Q147.C Q187.C Q227.C Q267.C Q307.C Q347.C Q387.C Q427.C Q467.C Q507.C Q547.C Q587.C Q627.C Q667.C Q707.C Q747.C Q787.C Q827.C Q867.C Q907.C Q947.C Q987.C Q1027.C Q1067.C Q1107.C Q1147.C Q1187.C
COL_27: Q28.C Q68.C Q108.C Q148.C Q188.C Q228.C Q268.C Q308.C Q348.C Q388.C Q428.C Q468.C Q508.C Q548.C Q588.C Q628.C Q668.C Q708.C Q748.C Q788.C Q828.C Q868.C Q908.C Q948.C Q988.C Q1028.C Q1068.C Q1108.C Q1148.C Q1188.C
COL_28: Q29.C Q69.C Q109.C Q149.C Q189.C Q229.C Q269.C Q309.C Q349.C Q389.C Q429.C Q469.C Q509.C Q549.C Q589.C Q629.C Q669.C Q709.C Q749.C Q789.C Q829.C Q869.C Q909.C Q949.C Q989.C Q1029.C Q1069.C Q1109.C Q1149.C Q1189.C
COL_29: Q30.C Q70.C Q110.C Q150.C Q190.C Q230.C Q270.C Q310.C Q350.C Q390.C Q430.C Q470.C Q510.C Q550.C Q590.C Q630.C Q670.C Q710.C Q750.C Q790.C Q830.C Q870.C Q910.C Q950.C Q990.C Q1030.C Q1070.C Q1110.C Q1150.C Q1190.C
COL_30: Q31.C Q71.C Q111.C Q151.C Q191.C Q231.C Q271.C Q311.C Q351.C Q391.C Q431.C Q471.C Q511.C Q551.C Q591.C Q631.C Q671.C Q711.C Q751.C Q791.C Q831.C Q871.C Q911.C Q951.C Q991.C Q1031.C Q1071.C Q1111.C Q1151.C Q1191.C
COL_31: Q32.C Q72.C Q112.C Q152.C Q192.C Q232.C Q272.C Q312.C Q352.C Q392.C Q432.C Q472.C Q512.C Q552.C Q592.C Q632.C Q672.C Q712.C Q752.C Q792.C Q832.C Q872.C Q912.C Q952.C Q992.C Q1032.C Q1072.C Q1112.C Q1152.C Q1192.C
COL_32: Q33.C Q73.C Q113.C Q153.C Q193.C Q233.C Q273.C Q313.C Q353.C Q393.C Q433.C Q473.C Q513.C Q553.C Q593.C Q633.C Q673.C Q713.C Q753.C Q793.C Q833.C Q873.C Q913.C Q953.C Q993.C Q1033.C Q1073.C Q1113.C Q1153.C Q1193.C
COL_33: Q34.C Q74.C Q114.C Q154.C Q194.C Q234.C Q274.C Q314.C Q354.C Q394.C Q434.C Q474.C Q514.C Q554.C Q594.C Q634.C Q674.C Q714.C Q754.C Q794.C Q834.C Q874.C Q914.C Q954.C Q994.C Q1034.C Q1074.C Q1114.C Q1154.C Q1194.C
COL_34: Q35.C Q75.C Q115.C Q155.C Q195.C Q235.C Q275.C Q315.C Q355.C Q395.C Q435.C Q475.C Q515.C Q555.C Q595.C Q635.C Q675.C Q715.C Q755.C Q795.C Q835.C Q875.C Q915.C Q955.C Q995.C Q1035.C Q1075.C Q1115.C Q1155.C Q1195.C
COL_35: Q36.C Q76.C Q116.C Q156.C Q196.C Q236.C Q276.C Q316.C Q356.C Q396.C Q436.C Q476.C Q516.C Q556.C Q596.C Q636.C Q676.C Q716.C Q756.C Q796.C Q836.C Q876.C Q916.C Q956.C Q996.C Q1036.C Q1076.C Q1116.C Q1156.C Q1196.C
COL_36: Q37.C Q77.C Q117.C Q157.C Q197.C Q237.C Q277.C Q317.C Q357.C Q397.C Q437.C Q477.C Q517.C Q557.C Q597.C Q637.C Q677.C Q717.C Q757.C Q797.C Q837.C Q877.C Q917.C Q957.C Q997.C Q1037.C Q1077.C Q1117.C Q1157.C Q1197.C
COL_37: Q38.C Q78.C Q118.C Q158.C Q198.C Q238.C Q278.C Q318.C Q358.C Q398.C Q438.C Q478.C Q518.C Q558.C Q598.C Q638.C Q678.C Q718.C Q758.C Q798.C Q838.C Q878.C Q918.C Q958.C Q998.C Q1038.C Q1078.C Q1118.C Q1158.C Q1198.C
COL_38: Q39.C Q79.C Q119.C Q159.C Q199.C Q239.C Q279.C Q319.C Q359.C Q399.C Q439.C Q479.C Q519.C Q559.C Q599.C Q639.C Q679.C Q719.C Q759.C Q799.C Q839.C Q879.C Q919.C Q959.C Q999.C Q1039.C Q1079.C Q1119.C Q1159.C Q1199.C
COL_39: Q40.C Q80.C Q120.C Q160.C Q200.C Q240.C Q280.C Q320.C Q360.C Q400.C Q440.C Q480.C Q520.C Q560.C Q600.C Q640.C Q680.C Q720.C Q760.C Q800.C Q840.C Q880.C Q920.C Q960.C Q1000.C Q1040.C Q1080.C Q1120.C Q1160.C Q1200.C
ROW_0: Q1.E Q2.E Q3.E Q4.E Q5.E Q6.E Q7.E Q8.E Q9.E Q10.E Q11.E Q12.E Q13.E Q14.E Q15.E Q16.E Q17.E Q18.E Q19.E Q20.E Q21.E Q22.E Q23.E Q24.E Q25.E Q26.E Q27.E Q28.E Q29.E Q30.E Q31.E Q32.E Q33.E Q34.E Q35.E Q36.E Q37.E Q38.E Q39.E Q40.E
ROW_1: Q41.E Q42.E Q43.E Q44.E Q45.E Q46.E Q47.E Q48.E Q49.E Q50.E Q51.E Q52.E Q53.E Q54.E Q55.E Q56.E Q57.E Q58.E Q59.E Q60.E Q61.E Q62.E Q63.E Q64.E Q65.E Q66.E Q67.E Q68.E Q69.E Q70.E Q71.E Q72.E Q73.E Q74.E Q75.E Q76.E Q77.E Q78.E Q79.E Q80.E
ROW_2: Q81.E Q82.E Q83.E Q84.E Q85.E Q86.E Q87.E Q88.E Q89.E Q90.E Q91.E Q92.E Q93.E Q94.E Q95.E Q96.E Q97.E Q98.E Q99.E Q100.E Q101.E Q102.E Q103.E Q104.E Q105.E Q106.E Q107.E Q108.E Q109.E Q110.E Q111.E Q112.E Q113.E Q114.E Q115.E Q116.E Q117.E Q118.E Q119.E Q120.E
ROW_3: Q121.E Q122.E Q123.E Q124.E Q125.E Q126.E Q127.E Q128.E Q129.E Q130.E Q131.E Q132.E Q133.E Q134.E Q135.E Q136.E Q137.E Q138.E Q139.E Q140.E Q141.E Q142.E Q143.E Q144.E Q145.E Q146.E Q147.E Q148.E Q149.E Q150.E Q151.E Q152.E Q153.E Q154.E Q155.E Q156.E Q157.E Q158.E Q159.E Q160.E
ROW_4: Q161.E Q162.E Q163.E Q164.E Q165.E Q166.E Q167.E Q168.E Q169.E Q170.E Q171.E Q172.E Q173.E Q174.E Q175.E Q176.E Q177.E Q178.E Q179.E Q180.E Q181.E Q182.E Q183.E Q184.E Q185.E Q186.E Q187.E Q188.E Q189.E Q190.E Q191.E Q192.E Q193.E Q194.E Q195.E Q196.E Q197.E Q198.E Q199.E Q200.E
ROW_5: Q201.E Q202.E Q203.E Q204.E Q205.E Q206.E Q207.E Q208.E Q209.E Q210.E Q211.E Q212.E Q213.E Q214.E Q215.E Q216.E Q217.E Q218.E Q219.E Q220.E Q221.E Q222.E Q223.E Q224.E Q225.E Q226.E Q227.E Q228.E Q229.E Q230.E Q231.E Q232.E Q233.E Q234.E Q235.E Q236.E Q237.E Q238.E Q239.E Q240.E
ROW_6: Q241.E Q242.E Q243.E Q244.E Q245.E Q246.E Q247.E Q248.E Q249.E Q250.E Q251.E Q252.E Q253.E Q254.E Q255.E Q256.E Q257.E Q258.E Q259.E Q260.E Q261.E Q262.E Q263.E Q264.E Q265.E Q266.E Q267.E Q268.E Q269.E Q270.E Q271.E Q272.E Q273.E Q274.E Q275.E Q276.E Q277.E Q278.E Q279.E Q280.E
ROW_7: Q281.E Q282.E Q283.E Q284.E Q285.E Q286.E Q287.E Q288.E Q289.E Q290.E Q291.E Q292.E Q293.E Q294.E Q295.E Q296.E Q297.E Q298.E Q299.E Q300.E Q301.E Q302.E Q303.E Q304.E Q305.E Q306.E Q307.E Q308.E Q309.E Q310.E Q311.E Q312.E Q313.E Q314.E Q315.E Q316.E Q317.E Q318.E Q319.E Q320.E
ROW_8: Q321.E Q322.E Q323.E Q324.E Q325.E Q326.E Q327.E Q328.E Q329.E Q330.E Q331.E Q332.E Q333.E Q334.E Q335.E Q336.E Q337.E Q338.E Q339.E Q340.E Q341.E Q342.E Q343.E Q344.E Q345.E Q346.E Q347.E Q348.E Q349.E Q350.E Q351.E Q352.E Q353.E Q354.E Q355.E Q356.E Q357.E Q358.E Q359.E Q360.E
ROW_9: Q361.E Q362.E Q363.E Q364.E Q365.E Q366.E Q367.E Q368.E Q369.E Q370.E Q371.E Q372.E Q373.E Q374.E Q375.E Q376.E Q377.E Q378.E Q379.E Q380.E Q381.E Q382.E Q383.E Q384.E Q385.E Q386.E Q387.E Q388.E Q389.E Q390.E Q391.E Q392.E Q393.E Q394.E Q395.E Q396.E Q397.E Q398.E Q399.E Q400.E
ROW_10: Q401.E Q402.E Q403.E Q404.E Q405.E Q406.E Q407.E Q408.E Q409.E Q410.E Q411.E Q412.E Q413.E Q414.E Q415.E Q416.E Q417.E Q418.E Q419.E Q420.E Q421.E Q422.E Q423.E Q424.E Q425.E Q426.E Q427.E Q428.E Q429.E Q430.E Q431.E Q432.E Q433.E Q434.E Q435.E Q436.E Q437.E Q438.E Q439.E Q440.E
ROW_11: Q441.E Q442.E Q443.E Q444.E Q445.E Q446.E Q447.E Q448.E Q449.E Q450.E Q451.E Q452.E Q453.E Q454.E Q455.E Q456.E Q457.E Q458.E Q459.E Q460.E Q461.E Q462.E Q463.E Q464.E Q465.E Q466.E Q467.E Q468.E Q469.E Q470.E Q471.E Q472.E Q473.E Q474.E Q475.E Q476.E Q477.E Q478.E Q479.E Q480.E
ROW_12: Q481.E Q482.E Q483.E Q484.E Q485.E Q486.E Q487.E Q488.E Q489.E Q490.E Q491.E Q492.E Q493.E Q494.E Q495.E Q496.E Q497.E Q498.E Q499.E Q500.E Q501.E Q502.E Q503.E Q504.E Q505.E Q506.E Q507.E Q508.E Q509.E Q510.E Q511.E Q512.E Q513.E Q514.E Q515.E Q516.E Q517.E Q518.E Q519.E Q520.E
ROW_13: Q521.E Q522.E Q523.E Q524.E Q525.E Q526.E Q527.E Q528.E Q529.E Q530.E Q531.E Q532.E Q533.E Q534.E Q535.E Q536.E Q537.E Q538.E Q539.E Q540.E Q541.E Q542.E Q543.E Q544.E Q545.E Q546.E Q547.E Q548.E Q549.E Q550.E Q551.E Q552.E Q553.E Q554.E Q555.E Q556.E Q557.E Q558.E Q559.E Q560.E
ROW_14: Q561.E Q562.E Q563.E Q564.E Q565.E Q566.E Q567.E Q568.E Q569.E Q570.E Q571.E Q572.E Q573.E Q574.E Q575.E Q576.E Q577.E Q578.E Q579.E Q580.E Q581.E Q582.E Q583.E Q584.E Q585.E Q586.E Q587.E Q588.E Q589.E Q590.E Q591.E Q592.E Q593.E Q594.E Q595.E Q596.E Q597.E Q598.E Q599.E Q600.E
ROW_15: Q601.E Q602.E Q603.E Q604.E Q605.E Q606.E Q607.E Q608.E Q609.E Q610.E Q611.E Q612.E Q613.E Q614.E Q615.E Q616.E Q617.E Q618.E Q619.E Q620.E Q621.E Q622.E Q623.E Q624.E Q625.E Q626.E Q627.E Q628.E Q629.E Q630.E Q631.E Q632.E Q633.E Q634.E Q635.E Q636.E Q637.E Q638.E Q639.E Q640.E
ROW_16: Q641.E Q642.E Q643.E Q644.E Q645.E Q646.E Q647.E Q648.E Q649.E Q650.E Q651.E Q652.E Q653.E Q654.E Q655.E Q656.E Q657.E Q658.E Q659.E Q660.E Q661.E Q662.E Q663.E Q664.E Q665.E Q666.E Q667.E Q668.E Q669.E Q670.E Q671.E Q672.E Q673.E Q674.E Q675.E Q676.E Q677.E Q678.E Q679.E Q680.E
ROW_17: Q681.E Q682.E Q683.E Q684.E Q685.E Q686.E Q687.E Q688.E Q689.E Q690.E Q691.E Q692.E Q693.E Q694.E Q695.E Q696.E Q697.E Q698.E Q699.E Q700.E Q701.E Q702.E Q703.E Q704.E Q705.E Q706.E Q707.E Q708.E Q709.E Q710.E Q711.E Q712.E Q713.E Q714.E Q715.E Q716.E Q717.E Q718.E Q719.E Q720.E
ROW_18: Q721.E Q722.E Q723.E Q724.E Q725.E Q726.E Q727.E Q728.E Q729.E Q730.E Q731.E Q732.E Q733.E Q734.E Q735.E Q736.E Q737.E Q738.E Q739.E Q740.E Q741.E Q742.E Q743.E Q744.E Q745.E Q746.E Q747.E Q748.E Q749.E Q750.E Q751.E Q752.E Q753.E Q754.E Q755.E Q756.E Q757.E Q758.E Q759.E Q760.E
ROW_19: Q761.E Q762.E Q763.E Q764.E Q765.E Q766.E Q767.E Q768.E Q769.E Q770.E Q771.E Q772.E Q773.E Q774.E Q775.E Q776.E Q777.E Q778.E Q779.E Q780.E Q781.E Q782.E Q783.E Q784.E Q785.E Q786.E Q787.E Q788.E Q789.E Q790.E Q791.E Q792.E Q793.E Q794.E Q795.E Q796.E Q797.E Q798.E Q799.E Q800.E
ROW_20: Q801.E Q802.E Q803.E Q804.E Q805.E Q806.E Q807.E Q808.E Q809.E Q810.E Q811.E Q812.E Q813.E Q814.E Q815.E Q816.E Q817.E Q818.E Q819.E Q820.E Q821.E Q822.E Q823.E Q824.E Q825.E Q826.E Q827.E Q828.E Q829.E Q830.E Q831.E Q832.E Q833.E Q834.E Q835.E Q836.E Q837.E Q838.E Q839.E Q840.E
ROW_21: Q841.E Q842.E Q843.E Q844.E Q845.E Q846.E Q847.E Q848.E Q849.E Q850.E Q851.E Q852.E Q853.E Q854.E Q855.E Q856.E Q857.E Q858.E Q859.E Q860.E Q861.E Q862.E Q863.E Q864.E Q865.E Q866.E Q867.E Q868.E Q869.E Q870.E Q871.E Q872.E Q873.E Q874.E Q875.E Q876.E Q877.E Q878.E Q879.E Q880.E
ROW_22: Q881.E Q882.E Q883.E Q884.E Q885.E Q886.E Q887.E Q888.E Q889.E Q890.E Q891.E Q892.E Q893.E Q894.E Q895.E Q896.E Q897.E Q898.E Q899.E Q900.E Q901.E Q902.E Q903.E Q904.E Q905.E Q906.E Q907.E Q908.E Q909.E Q910.E Q911.E Q912.E Q913.E Q914.E Q915.E Q916.E Q917.E Q918.E Q919.E Q920.E
ROW_23: Q921.E Q922.E Q923.E Q924.E Q925.E Q926.E Q927.E Q928.E Q929.E Q930.E Q931.E Q932.E Q933.E Q934.E Q935.E Q936.E Q937.E Q938.E Q939.E Q940.E Q941.E Q942.E Q943.E Q944.E Q945.E Q946.E Q947.E Q948.E Q949.E Q950.E Q951.E Q952.E Q953.E Q954.E Q955.E Q956.E Q957.E Q958.E Q959.E Q960.E
ROW_24: Q961.E Q962.E Q963.E Q964.E Q965.E Q966.E Q967.E Q968.E Q969.E Q970.E Q971.E Q972.E Q973.E Q974.E Q975.E Q976.E Q977.E Q978.E Q979.E Q980.E Q981.E Q982.E Q983.E Q984.E Q985.E Q986.E Q987.E Q988.E Q989.E Q990.E Q991.E Q992.E Q993.E Q994.E Q995.E Q996.E Q997.E Q998.E Q999.E Q1000.E
ROW_25: Q1001.E Q1002.E Q1003.E Q1004.E Q1005.E Q1006.E Q1007.E Q1008.E Q1009.E Q1010.E Q1011.E Q1012.E Q1013.E Q1014.E Q1015.E Q1016.E Q1017.E Q1018.E Q1019.E Q1020.E Q1021.E Q1022.E Q1023.E Q1024.E Q1025.E Q1026.E Q1027.E Q1028.E Q1029.E Q1030.E Q1031.E Q1032.E Q1033.E Q1034.E Q1035.E Q1036.E Q1037.E Q1038.E Q1039.E Q1040.E
ROW_26: Q1041.E Q1042.E Q1043.E Q1044.E Q1045.E Q1046.E Q1047.E Q1048.E Q1049.E Q1050.E Q1051.E Q1052.E Q1053.E Q1054.E Q1055.E Q1056.E Q1057.E Q1058.E Q1059.E Q1060.E Q1061.E Q1062.E Q1063.E Q1064.E Q1065.E Q1066.E Q1067.E Q1068.E Q1069.E Q1070.E Q1071.E Q1072.E Q1073.E Q1074.E Q1075.E Q1076.E Q1077.E Q1078.E Q1079.E Q1080.E
ROW_27: Q1081.E Q1082.E Q1083.E Q1084.E Q1085.E Q1086.E Q1087.E Q1088.E Q1089.E Q1090.E Q1091.E Q1092.E Q1093.E Q1094.E Q1095.E Q1096.E Q1097.E Q1098.E Q1099.E Q1100.E Q1101.E Q1102.E Q1103.E Q1104.E Q1105.E Q1106.E Q1107.E Q1108.E Q1109.E Q1110.E Q1111.E Q1112.E Q1113.E Q1114.E Q1115.E Q1116.E Q1117.E Q1118.E Q1119.E Q1120.E
ROW_28: Q1121.E Q1122.E Q1123.E Q1124.E Q1125.E Q1126.E Q1127.E Q1128.E Q1129.E Q1130.E Q1131.E Q1132.E Q1133.E Q1134.E Q1135.E Q1136.E Q1137.E Q1138.E Q1139.E Q1140.E Q1141.E Q1142.E Q1143.E Q1144.E Q1145.E Q1146.E Q1147.E Q1148.E Q1149.E Q1150.E Q1151.E Q1152.E Q1153.E Q1154.E Q1155.E Q1156.E Q1157.E Q1158.E Q1159.E Q1160.E
ROW_29: Q1161.E Q1162.E Q1163.E Q1164.E Q1165.E Q1166.E Q1167.E Q1168.E Q1169.E Q1170.E Q1171.E Q1172.E Q1173.E Q1174.E Q1175.E Q1176.E Q1177.E Q1178.E Q1179.E Q1180.E Q1181.E Q1182.E Q1183.E Q1184.E Q1185.E Q1186.E Q1187.E Q1188.E Q1189.E Q1190.E Q1191.E Q1192.E Q1193.E Q1194.E Q1195.E Q1196.E Q1197.E Q1198.E Q1199.E Q1200.E

## Buses and harness runs
bus COL_[39...0] = port COL_[39...0]
bus ROW_[29...0] = port ROW_[29...0]

## Library data of the parts
Q1-Q1200 = PT0805CS: Phototransistor